# Altium schematic sheet 10.RK3588_Power_GND.SchDoc
size 594 x 420 mm; Revision: V2.1; Schematic Page Number: 11; Page Number: 10; Check: <Checker>; Schematic Name: RK_NVR_DEMO1_RK3588_LP4/4x_V21; Page Count: 43; Page name: 10.RK3588_Power/GND; Designer: Zhangdz; Schematic Page Count: 99; Revcode: V2.1; DsnPath: E:\Work\SBER\RK3588_SOM\temp\RK_NVR_DEMO1_RK3588_LP4XD200P232SD8_V21_20211228.DSN; SchematicName: RK_NVR_DEMO1_RK3588_LP4/4x_V21; PageName: 10.RK3588_Power/GND; PageSize: A2; TopSchematic: True
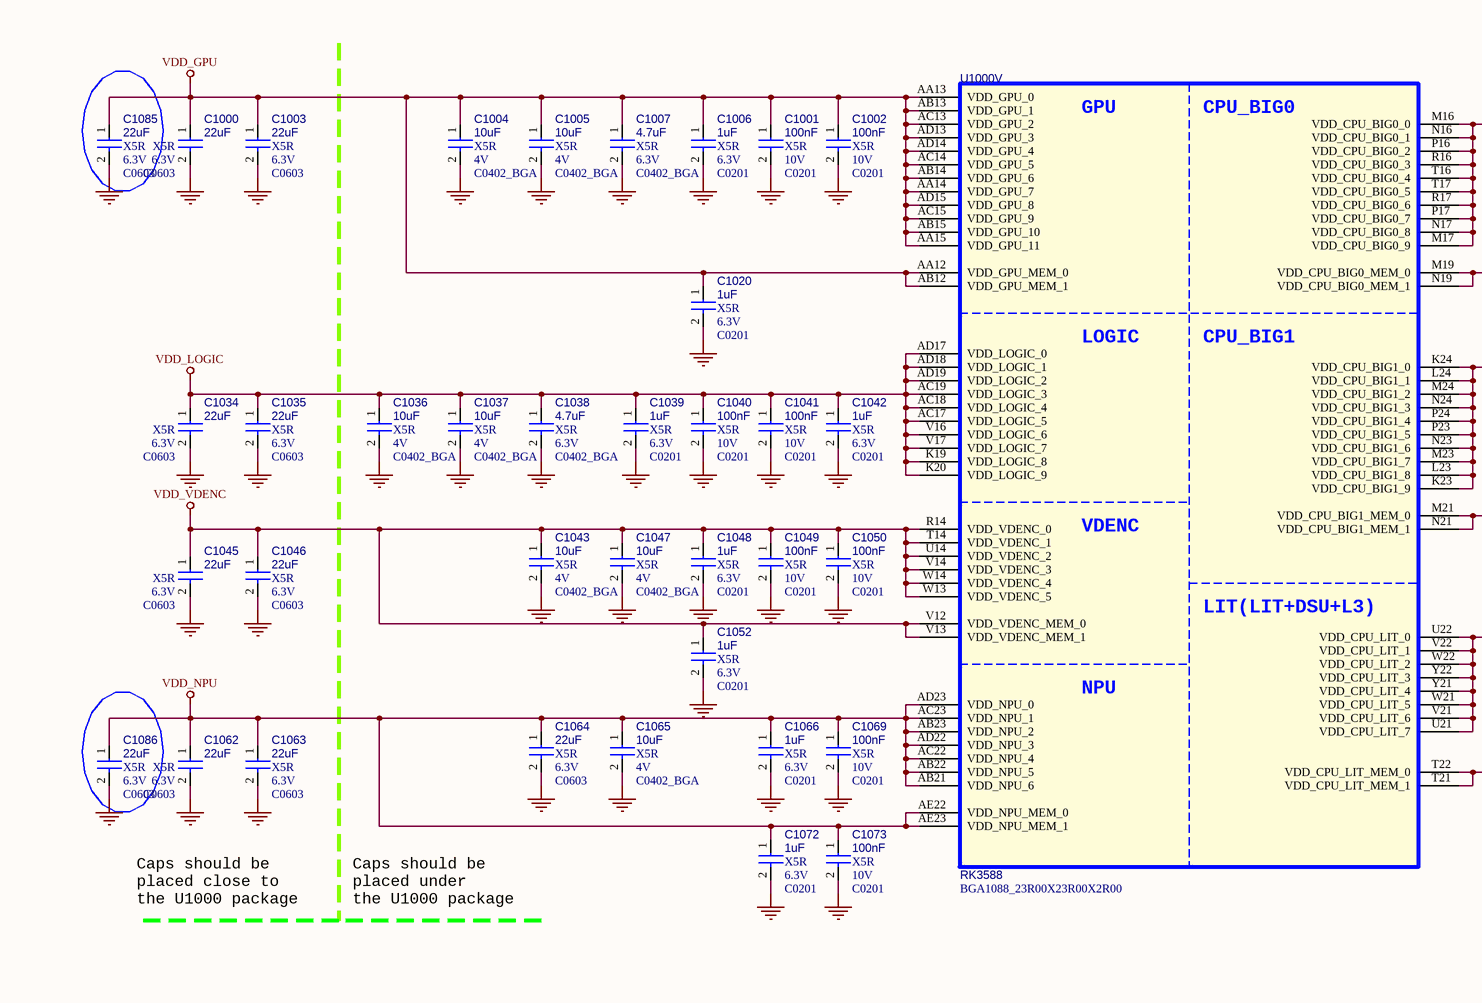
[diagram p0: 10.RK3588_Power_GND.SchDoc, top left]
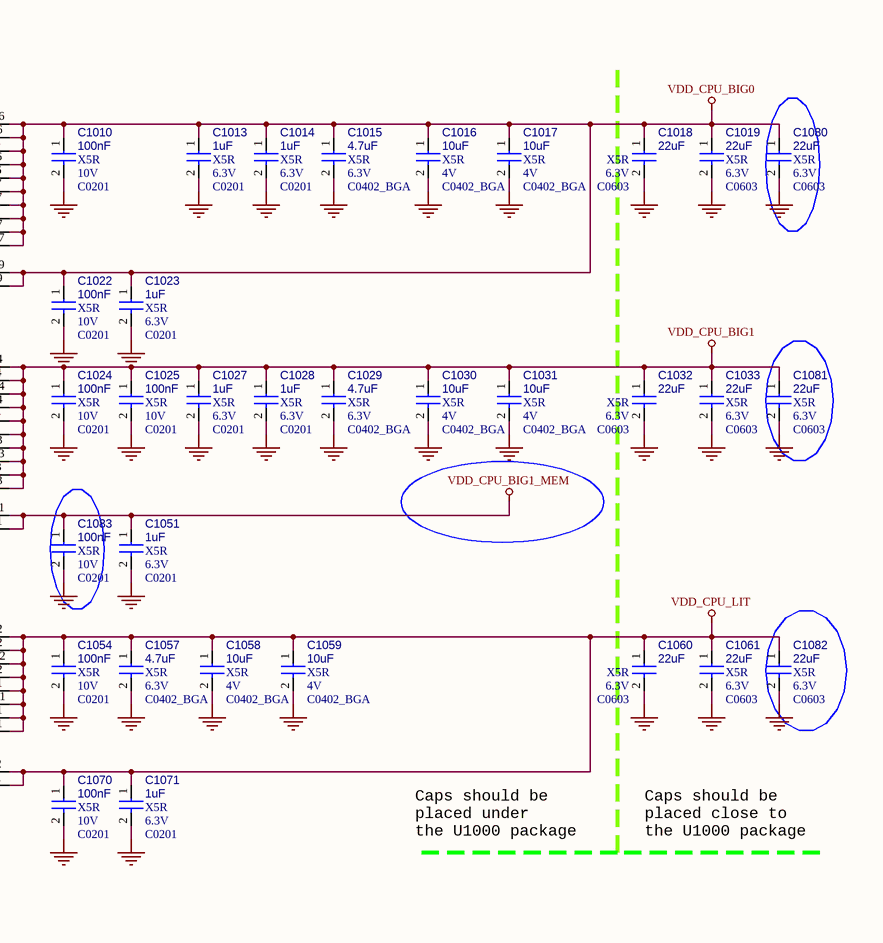
[diagram p1: 10.RK3588_Power_GND.SchDoc, top right]
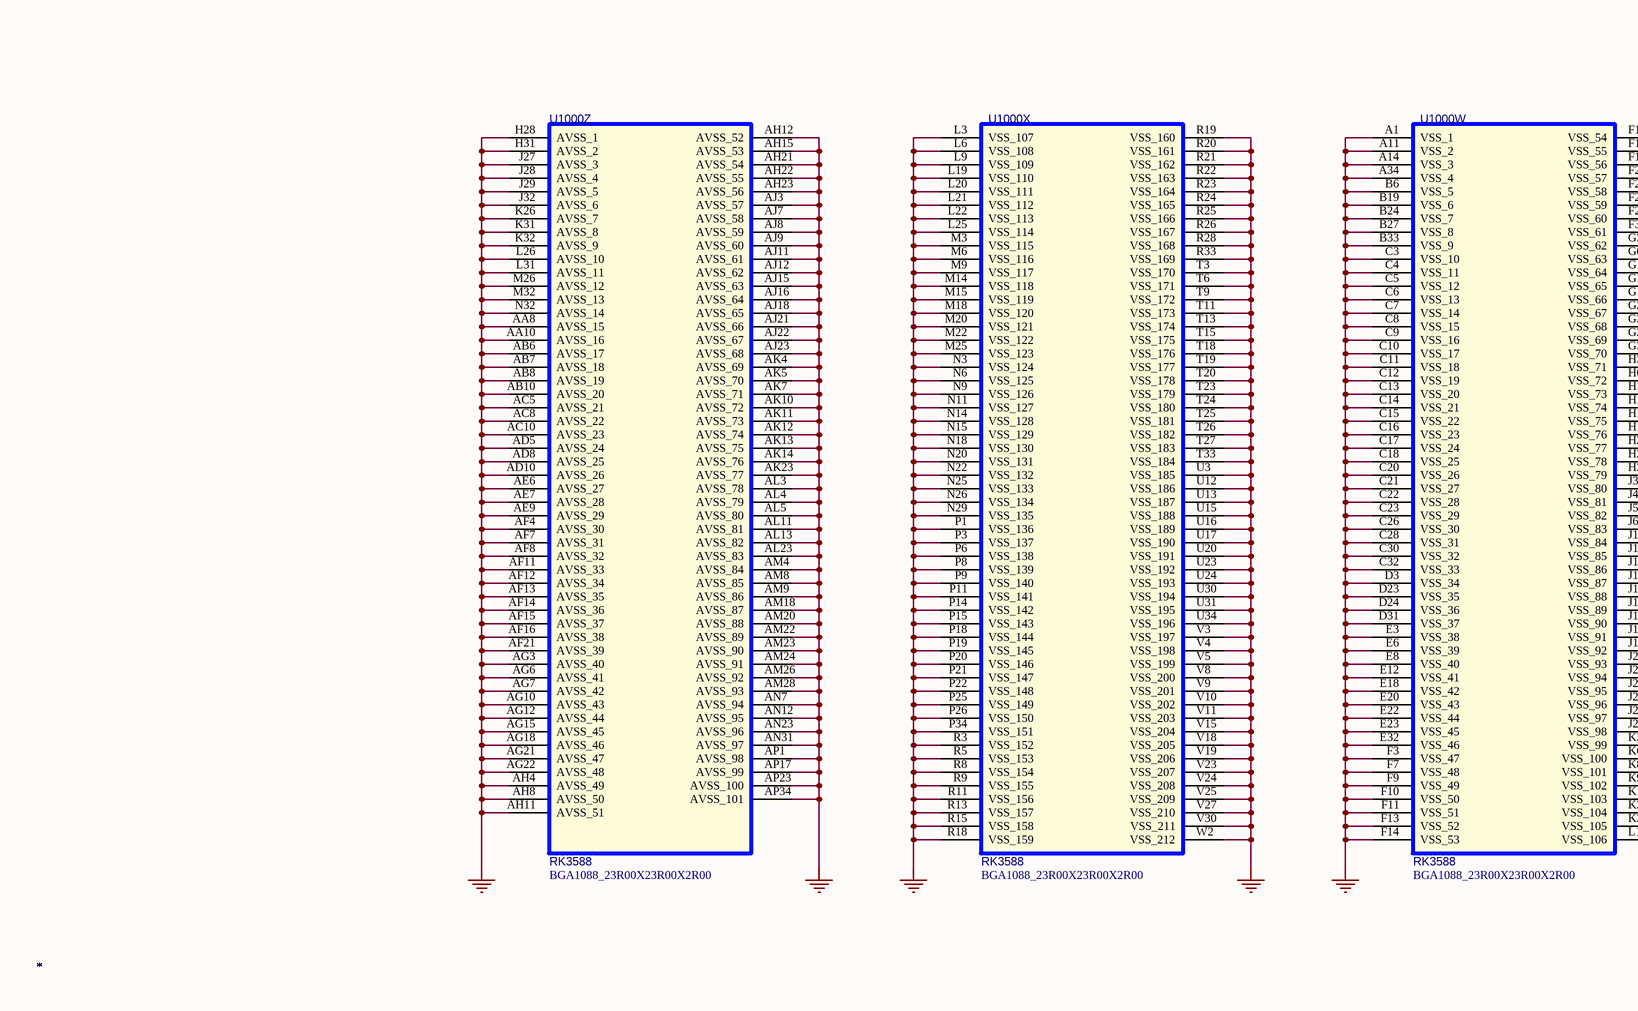
[diagram p2: 10.RK3588_Power_GND.SchDoc, bottom left]
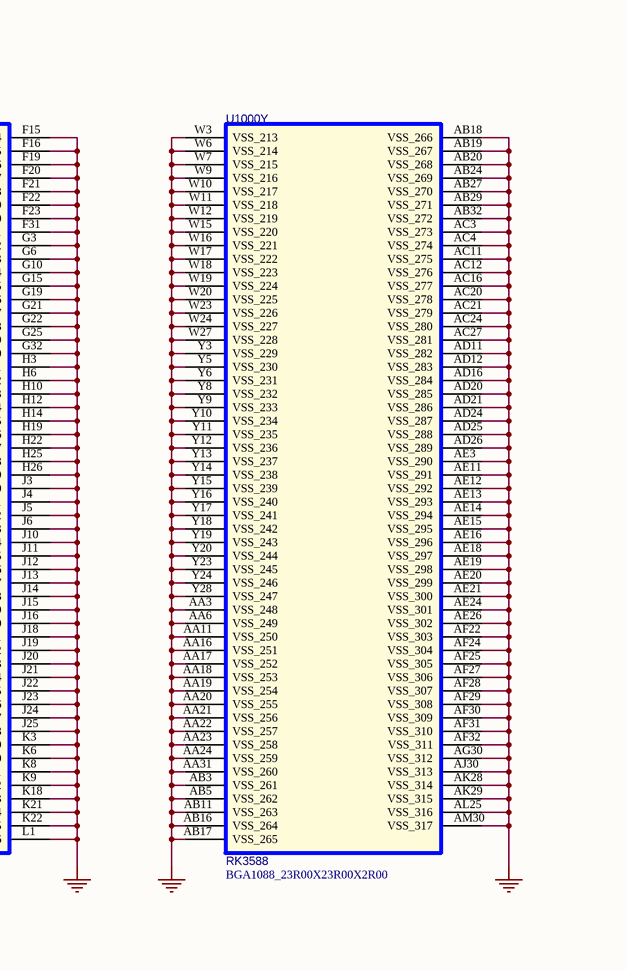
[diagram p3: 10.RK3588_Power_GND.SchDoc, bottom right]

## Parts
C1000  *  Voltage: 6.3V  Dielectric: X5R  [C0603]
C1001  *  Voltage: 10V  Dielectric: X5R  [C0201]
C1002  *  Voltage: 10V  Dielectric: X5R  [C0201]
C1003  *  Voltage: 6.3V  Dielectric: X5R  [C0603]
C1004  *  Voltage: 4V  Dielectric: X5R  [C0402_BGA]
C1005  *  Voltage: 4V  Dielectric: X5R  [C0402_BGA]
C1006  *  Voltage: 6.3V  Dielectric: X5R  [C0201]
C1007  *  Voltage: 6.3V  Dielectric: X5R  [C0402_BGA]
C1010  *  Voltage: 10V  Dielectric: X5R  [C0201]
C1013  *  Voltage: 6.3V  Dielectric: X5R  [C0201]
C1014  *  Voltage: 6.3V  Dielectric: X5R  [C0201]
C1015  *  Voltage: 6.3V  Dielectric: X5R  [C0402_BGA]
C1016  *  Voltage: 4V  Dielectric: X5R  [C0402_BGA]
C1017  *  Voltage: 4V  Dielectric: X5R  [C0402_BGA]
C1018  *  Voltage: 6.3V  Dielectric: X5R  [C0603]
C1019  *  Voltage: 6.3V  Dielectric: X5R  [C0603]
C1020  *  Voltage: 6.3V  Dielectric: X5R  [C0201]
C1022  *  Voltage: 10V  Dielectric: X5R  [C0201]
C1023  *  Voltage: 6.3V  Dielectric: X5R  [C0201]
C1024  *  Voltage: 10V  Dielectric: X5R  [C0201]
C1025  *  Voltage: 10V  Dielectric: X5R  [C0201]
C1027  *  Voltage: 6.3V  Dielectric: X5R  [C0201]
C1028  *  Voltage: 6.3V  Dielectric: X5R  [C0201]
C1029  *  Voltage: 6.3V  Dielectric: X5R  [C0402_BGA]
C1030  *  Voltage: 4V  Dielectric: X5R  [C0402_BGA]
C1031  *  Voltage: 4V  Dielectric: X5R  [C0402_BGA]
C1032  *  Voltage: 6.3V  Dielectric: X5R  [C0603]
C1033  *  Voltage: 6.3V  Dielectric: X5R  [C0603]
C1034  *  Voltage: 6.3V  Dielectric: X5R  [C0603]
C1035  *  Voltage: 6.3V  Dielectric: X5R  [C0603]
C1036  *  Voltage: 4V  Dielectric: X5R  [C0402_BGA]
C1037  *  Voltage: 4V  Dielectric: X5R  [C0402_BGA]
C1038  *  Voltage: 6.3V  Dielectric: X5R  [C0402_BGA]
C1039  *  Voltage: 6.3V  Dielectric: X5R  [C0201]
C1040  *  Voltage: 10V  Dielectric: X5R  [C0201]
C1041  *  Voltage: 10V  Dielectric: X5R  [C0201]
C1042  *  Voltage: 6.3V  Dielectric: X5R  [C0201]
C1043  *  Voltage: 4V  Dielectric: X5R  [C0402_BGA]
C1045  *  Voltage: 6.3V  Dielectric: X5R  [C0603]
C1046  *  Voltage: 6.3V  Dielectric: X5R  [C0603]
C1047  *  Voltage: 4V  Dielectric: X5R  [C0402_BGA]
C1048  *  Voltage: 6.3V  Dielectric: X5R  [C0201]
C1049  *  Voltage: 10V  Dielectric: X5R  [C0201]
C1050  *  Voltage: 10V  Dielectric: X5R  [C0201]
C1051  *  Voltage: 6.3V  Dielectric: X5R  [C0201]
C1052  *  Voltage: 6.3V  Dielectric: X5R  [C0201]
C1054  *  Voltage: 10V  Dielectric: X5R  [C0201]
C1057  *  Voltage: 6.3V  Dielectric: X5R  [C0402_BGA]
C1058  *  Voltage: 4V  Dielectric: X5R  [C0402_BGA]
C1059  *  Voltage: 4V  Dielectric: X5R  [C0402_BGA]
C1060  *  Voltage: 6.3V  Dielectric: X5R  [C0603]
C1061  *  Voltage: 6.3V  Dielectric: X5R  [C0603]
C1062  *  Voltage: 6.3V  Dielectric: X5R  [C0603]
C1063  *  Voltage: 6.3V  Dielectric: X5R  [C0603]
C1064  *  Voltage: 6.3V  Dielectric: X5R  [C0603]
C1065  *  Voltage: 4V  Dielectric: X5R  [C0402_BGA]
C1066  *  Voltage: 6.3V  Dielectric: X5R  [C0201]
C1069  *  Voltage: 10V  Dielectric: X5R  [C0201]
C1070  *  Voltage: 10V  Dielectric: X5R  [C0201]
C1071  *  Voltage: 6.3V  Dielectric: X5R  [C0201]
C1072  *  Voltage: 6.3V  Dielectric: X5R  [C0201]
C1073  *  Voltage: 10V  Dielectric: X5R  [C0201]
C1080  *  Voltage: 6.3V  Dielectric: X5R  [C0603]
C1081  *  Voltage: 6.3V  Dielectric: X5R  [C0603]
C1082  *  Voltage: 6.3V  Dielectric: X5R  [C0603]
C1083  *  Voltage: 10V  Dielectric: X5R  [C0201]
C1085  *  Voltage: 6.3V  Dielectric: X5R  [C0603]
C1086  *  Voltage: 6.3V  Dielectric: X5R  [C0603]
U1000  *  [BGA1088_23R00X23R00X2R00]  (parts V,W,X,Y,Z of 26)

## Nets
GND: C1000.2 C1001.2 C1002.2 C1003.2 C1004.2 C1005.2 C1006.2 C1007.2 C1010.2 C1013.2 C1014.2 C1015.2 C1016.2 C1017.2 C1018.2 C1019.2 C1020.2 C1022.2 C1023.2 C1024.2 C1025.2 C1027.2 C1028.2 C1029.2 C1030.2 C1031.2 C1032.2 C1033.2 C1034.2 C1035.2 C1036.2 C1037.2 C1038.2 C1039.2 C1040.2 C1041.2 C1042.2 C1043.2 C1045.2 C1046.2 C1047.2 C1048.2 C1049.2 C1050.2 C1051.2 C1052.2 C1054.2 C1057.2 C1058.2 C1059.2 C1060.2 C1061.2 C1062.2 C1063.2 C1064.2 C1065.2 C1066.2 C1069.2 C1070.2 C1071.2 C1072.2 C1073.2 C1080.2 C1081.2 C1082.2 C1083.2 C1085.2 C1086.2 U1000.A1(VSS_1) U1000.A11(VSS_2) U1000.A14(VSS_3) U1000.A34(VSS_4) U1000.AA3(VSS_248) U1000.AA6(VSS_249) U1000.AA8(AVSS_15) U1000.AA10(AVSS_16) U1000.AA11(VSS_250) U1000.AA16(VSS_251) U1000.AA17(VSS_252) U1000.AA18(VSS_253) U1000.AA19(VSS_254) U1000.AA20(VSS_255) U1000.AA21(VSS_256) U1000.AA22(VSS_257) U1000.AA23(VSS_258) U1000.AA24(VSS_259) U1000.AA31(VSS_260) U1000.AB3(VSS_261) U1000.AB5(VSS_262) U1000.AB6(AVSS_17) U1000.AB7(AVSS_18) U1000.AB8(AVSS_19) U1000.AB10(AVSS_20) U1000.AB11(VSS_263) U1000.AB16(VSS_264) U1000.AB17(VSS_265) U1000.AB18(VSS_266) U1000.AB19(VSS_267) U1000.AB20(VSS_268) U1000.AB24(VSS_269) U1000.AB27(VSS_270) U1000.AB29(VSS_271) U1000.AB32(VSS_272) U1000.AC3(VSS_273) U1000.AC4(VSS_274) U1000.AC5(AVSS_21) U1000.AC8(AVSS_22) U1000.AC10(AVSS_23) U1000.AC11(VSS_275) U1000.AC12(VSS_276) U1000.AC16(VSS_277) U1000.AC20(VSS_278) U1000.AC21(VSS_279) U1000.AC24(VSS_280) U1000.AC27(VSS_281) U1000.AD5(AVSS_24) U1000.AD8(AVSS_25) U1000.AD10(AVSS_26) U1000.AD11(VSS_282) U1000.AD12(VSS_283) U1000.AD16(VSS_284) U1000.AD20(VSS_285) U1000.AD21(VSS_286) U1000.AD24(VSS_287) U1000.AD25(VSS_288) U1000.AD26(VSS_289) U1000.AE3(VSS_290) U1000.AE6(AVSS_27) U1000.AE7(AVSS_28) U1000.AE9(AVSS_29) U1000.AE11(VSS_291) U1000.AE12(VSS_292) U1000.AE13(VSS_293) U1000.AE14(VSS_294) U1000.AE15(VSS_295) U1000.AE16(VSS_296) U1000.AE18(VSS_297) U1000.AE19(VSS_298) U1000.AE20(VSS_299) U1000.AE21(VSS_300) U1000.AE24(VSS_301) U1000.AE26(VSS_302) U1000.AF4(AVSS_30) U1000.AF7(AVSS_31) U1000.AF8(AVSS_32) U1000.AF11(AVSS_33) U1000.AF12(AVSS_34) U1000.AF13(AVSS_35) U1000.AF14(AVSS_36) U1000.AF15(AVSS_37) U1000.AF16(AVSS_38) U1000.AF21(AVSS_39) U1000.AF22(VSS_303) U1000.AF24(VSS_304) U1000.AF25(VSS_305) U1000.AF27(VSS_306) U1000.AF28(VSS_307) U1000.AF29(VSS_308) U1000.AF30(VSS_309) U1000.AF31(VSS_310) U1000.AF32(VSS_311) U1000.AG3(AVSS_40) U1000.AG6(AVSS_41) U1000.AG7(AVSS_42) U1000.AG10(AVSS_43) U1000.AG12(AVSS_44) U1000.AG15(AVSS_45) U1000.AG18(AVSS_46) U1000.AG21(AVSS_47) U1000.AG22(AVSS_48) U1000.AG30(VSS_312) U1000.AH4(AVSS_49) U1000.AH8(AVSS_50) U1000.AH11(AVSS_51) U1000.AH12(AVSS_52) U1000.AH15(AVSS_53) U1000.AH21(AVSS_54) U1000.AH22(AVSS_55) U1000.AH23(AVSS_56) U1000.AJ3(AVSS_57) U1000.AJ7(AVSS_58) U1000.AJ8(AVSS_59) U1000.AJ9(AVSS_60) U1000.AJ11(AVSS_61) U1000.AJ12(AVSS_62) U1000.AJ15(AVSS_63) U1000.AJ16(AVSS_64) U1000.AJ18(AVSS_65) U1000.AJ21(AVSS_66) U1000.AJ22(AVSS_67) U1000.AJ23(AVSS_68) U1000.AJ30(VSS_313) U1000.AK4(AVSS_69) U1000.AK5(AVSS_70) U1000.AK7(AVSS_71) U1000.AK10(AVSS_72) U1000.AK11(AVSS_73) U1000.AK12(AVSS_74) U1000.AK13(AVSS_75) U1000.AK14(AVSS_76) U1000.AK23(AVSS_77) U1000.AK28(VSS_314) U1000.AK29(VSS_315) U1000.AL3(AVSS_78) U1000.AL4(AVSS_79) U1000.AL5(AVSS_80) U1000.AL11(AVSS_81) U1000.AL13(AVSS_82) U1000.AL23(AVSS_83) U1000.AL25(VSS_316) U1000.AM4(AVSS_84) U1000.AM8(AVSS_85) U1000.AM9(AVSS_86) U1000.AM18(AVSS_87) U1000.AM20(AVSS_88) U1000.AM22(AVSS_89) U1000.AM23(AVSS_90) U1000.AM24(AVSS_91) U1000.AM26(AVSS_92) U1000.AM28(AVSS_93) U1000.AM30(VSS_317) U1000.AN7(AVSS_94) U1000.AN12(AVSS_95) U1000.AN23(AVSS_96) U1000.AN31(AVSS_97) U1000.AP1(AVSS_98) U1000.AP17(AVSS_99) U1000.AP23(AVSS_100) U1000.AP34(AVSS_101) U1000.B6(VSS_5) U1000.B19(VSS_6) U1000.B24(VSS_7) U1000.B27(VSS_8) U1000.B33(VSS_9) U1000.C3(VSS_10) U1000.C4(VSS_11) U1000.C5(VSS_12) U1000.C6(VSS_13) U1000.C7(VSS_14) U1000.C8(VSS_15) U1000.C9(VSS_16) U1000.C10(VSS_17) U1000.C11(VSS_18) U1000.C12(VSS_19) U1000.C13(VSS_20) U1000.C14(VSS_21) U1000.C15(VSS_22) U1000.C16(VSS_23) U1000.C17(VSS_24) U1000.C18(VSS_25) U1000.C20(VSS_26) U1000.C21(VSS_27) U1000.C22(VSS_28) U1000.C23(VSS_29) U1000.C26(VSS_30) U1000.C28(VSS_31) U1000.C30(VSS_32) U1000.C32(VSS_33) U1000.D3(VSS_34) U1000.D23(VSS_35) U1000.D24(VSS_36) U1000.D31(VSS_37) U1000.E3(VSS_38) U1000.E6(VSS_39) U1000.E8(VSS_40) U1000.E12(VSS_41) U1000.E18(VSS_42) U1000.E20(VSS_43) U1000.E22(VSS_44) U1000.E23(VSS_45) U1000.E32(VSS_46) U1000.F3(VSS_47) U1000.F7(VSS_48) U1000.F9(VSS_49) U1000.F10(VSS_50) U1000.F11(VSS_51) U1000.F13(VSS_52) U1000.F14(VSS_53) U1000.F15(VSS_54) U1000.F16(VSS_55) U1000.F19(VSS_56) U1000.F20(VSS_57) U1000.F21(VSS_58) U1000.F22(VSS_59) U1000.F23(VSS_60) U1000.F31(VSS_61) U1000.G3(VSS_62) U1000.G6(VSS_63) U1000.G10(VSS_64) U1000.G15(VSS_65) U1000.G19(VSS_66) U1000.G21(VSS_67) U1000.G22(VSS_68) U1000.G25(VSS_69) U1000.G32(VSS_70) U1000.H3(VSS_71) U1000.H6(VSS_72) U1000.H10(VSS_73) U1000.H12(VSS_74) U1000.H14(VSS_75) U1000.H19(VSS_76) U1000.H22(VSS_77) U1000.H25(VSS_78) U1000.H26(VSS_79) U1000.H28(AVSS_1) U1000.H31(AVSS_2) U1000.J3(VSS_80) U1000.J4(VSS_81) U1000.J5(VSS_82) U1000.J6(VSS_83) U1000.J10(VSS_84) U1000.J11(VSS_85) U1000.J12(VSS_86) U1000.J13(VSS_87) U1000.J14(VSS_88) U1000.J15(VSS_89) U1000.J16(VSS_90) U1000.J18(VSS_91) U1000.J19(VSS_92) U1000.J20(VSS_93) U1000.J21(VSS_94) U1000.J22(VSS_95) U1000.J23(VSS_96) U1000.J24(VSS_97) U1000.J25(VSS_98) U1000.J27(AVSS_3) U1000.J28(AVSS_4) U1000.J29(AVSS_5) U1000.J32(AVSS_6) U1000.K3(VSS_99) U1000.K6(VSS_100) U1000.K8(VSS_101) U1000.K9(VSS_102) U1000.K18(VSS_103) U1000.K21(VSS_104) U1000.K22(VSS_105) U1000.K26(AVSS_7) U1000.K31(AVSS_8) U1000.K32(AVSS_9) U1000.L1(VSS_106) U1000.L3(VSS_107) U1000.L6(VSS_108) U1000.L9(VSS_109) U1000.L19(VSS_110) U1000.L20(VSS_111) U1000.L21(VSS_112) U1000.L22(VSS_113) U1000.L25(VSS_114) U1000.L26(AVSS_10) U1000.L31(AVSS_11) U1000.M3(VSS_115) U1000.M6(VSS_116) U1000.M9(VSS_117) U1000.M14(VSS_118) U1000.M15(VSS_119) U1000.M18(VSS_120) U1000.M20(VSS_121) U1000.M22(VSS_122) U1000.M25(VSS_123) U1000.M26(AVSS_12) U1000.M32(AVSS_13) U1000.N3(VSS_124) U1000.N6(VSS_125) U1000.N9(VSS_126) U1000.N11(VSS_127) U1000.N14(VSS_128) U1000.N15(VSS_129) U1000.N18(VSS_130) U1000.N20(VSS_131) U1000.N22(VSS_132) U1000.N25(VSS_133) U1000.N26(VSS_134) U1000.N29(VSS_135) U1000.N32(AVSS_14) U1000.P1(VSS_136) U1000.P3(VSS_137) U1000.P6(VSS_138) U1000.P8(VSS_139) U1000.P9(VSS_140) U1000.P11(VSS_141) U1000.P14(VSS_142) U1000.P15(VSS_143) U1000.P18(VSS_144) U1000.P19(VSS_145) U1000.P20(VSS_146) U1000.P21(VSS_147) U1000.P22(VSS_148) U1000.P25(VSS_149) U1000.P26(VSS_150) U1000.P34(VSS_151) U1000.R3(VSS_152) U1000.R5(VSS_153) U1000.R8(VSS_154) U1000.R9(VSS_155) U1000.R11(VSS_156) U1000.R13(VSS_157) U1000.R15(VSS_158) U1000.R18(VSS_159) U1000.R19(VSS_160) U1000.R20(VSS_161) U1000.R21(VSS_162) U1000.R22(VSS_163) U1000.R23(VSS_164) U1000.R24(VSS_165) U1000.R25(VSS_166) U1000.R26(VSS_167) U1000.R28(VSS_168) U1000.R33(VSS_169) U1000.T3(VSS_170) U1000.T6(VSS_171) U1000.T9(VSS_172) U1000.T11(VSS_173) U1000.T13(VSS_174) U1000.T15(VSS_175) U1000.T18(VSS_176) U1000.T19(VSS_177) U1000.T20(VSS_178) U1000.T23(VSS_179) U1000.T24(VSS_180) U1000.T25(VSS_181) U1000.T26(VSS_182) U1000.T27(VSS_183) U1000.T33(VSS_184) U1000.U3(VSS_185) U1000.U12(VSS_186) U1000.U13(VSS_187) U1000.U15(VSS_188) U1000.U16(VSS_189) U1000.U17(VSS_190) U1000.U20(VSS_191) U1000.U23(VSS_192) U1000.U24(VSS_193) U1000.U30(VSS_194) U1000.U31(VSS_195) U1000.U34(VSS_196) U1000.V3(VSS_197) U1000.V4(VSS_198) U1000.V5(VSS_199) U1000.V8(VSS_200) U1000.V9(VSS_201) U1000.V10(VSS_202) U1000.V11(VSS_203) U1000.V15(VSS_204) U1000.V18(VSS_205) U1000.V19(VSS_206) U1000.V23(VSS_207) U1000.V24(VSS_208) U1000.V25(VSS_209) U1000.V27(VSS_210) U1000.V30(VSS_211) U1000.W2(VSS_212) U1000.W3(VSS_213) U1000.W6(VSS_214) U1000.W7(VSS_215) U1000.W9(VSS_216) U1000.W10(VSS_217) U1000.W11(VSS_218) U1000.W12(VSS_219) U1000.W15(VSS_220) U1000.W16(VSS_221) U1000.W17(VSS_222) U1000.W18(VSS_223) U1000.W19(VSS_224) U1000.W20(VSS_225) U1000.W23(VSS_226) U1000.W24(VSS_227) U1000.W27(VSS_228) U1000.Y3(VSS_229) U1000.Y5(VSS_230) U1000.Y6(VSS_231) U1000.Y8(VSS_232) U1000.Y9(VSS_233) U1000.Y10(VSS_234) U1000.Y11(VSS_235) U1000.Y12(VSS_236) U1000.Y13(VSS_237) U1000.Y14(VSS_238) U1000.Y15(VSS_239) U1000.Y16(VSS_240) U1000.Y17(VSS_241) U1000.Y18(VSS_242) U1000.Y19(VSS_243) U1000.Y20(VSS_244) U1000.Y23(VSS_245) U1000.Y24(VSS_246) U1000.Y28(VSS_247)
VDD_CPU_BIG0: C1010.1 C1013.1 C1014.1 C1015.1 C1016.1 C1017.1 C1018.1 C1019.1 C1022.1 C1023.1 C1080.1 U1000.M16(VDD_CPU_BIG0_0) U1000.M17(VDD_CPU_BIG0_9) U1000.M19(VDD_CPU_BIG0_MEM_0) U1000.N16(VDD_CPU_BIG0_1) U1000.N17(VDD_CPU_BIG0_8) U1000.N19(VDD_CPU_BIG0_MEM_1) U1000.P16(VDD_CPU_BIG0_2) U1000.P17(VDD_CPU_BIG0_7) U1000.R16(VDD_CPU_BIG0_3) U1000.R17(VDD_CPU_BIG0_6) U1000.T16(VDD_CPU_BIG0_4) U1000.T17(VDD_CPU_BIG0_5)
VDD_CPU_BIG1: C1024.1 C1025.1 C1027.1 C1028.1 C1029.1 C1030.1 C1031.1 C1032.1 C1033.1 C1081.1 U1000.K23(VDD_CPU_BIG1_9) U1000.K24(VDD_CPU_BIG1_0) U1000.L23(VDD_CPU_BIG1_8) U1000.L24(VDD_CPU_BIG1_1) U1000.M23(VDD_CPU_BIG1_7) U1000.M24(VDD_CPU_BIG1_2) U1000.N23(VDD_CPU_BIG1_6) U1000.N24(VDD_CPU_BIG1_3) U1000.P23(VDD_CPU_BIG1_5) U1000.P24(VDD_CPU_BIG1_4)
VDD_CPU_BIG1_MEM: C1051.1 C1083.1 U1000.M21(VDD_CPU_BIG1_MEM_0) U1000.N21(VDD_CPU_BIG1_MEM_1)
VDD_CPU_LIT: C1054.1 C1057.1 C1058.1 C1059.1 C1060.1 C1061.1 C1070.1 C1071.1 C1082.1 U1000.T21(VDD_CPU_LIT_MEM_1) U1000.T22(VDD_CPU_LIT_MEM_0) U1000.U21(VDD_CPU_LIT_7) U1000.U22(VDD_CPU_LIT_0) U1000.V21(VDD_CPU_LIT_6) U1000.V22(VDD_CPU_LIT_1) U1000.W21(VDD_CPU_LIT_5) U1000.W22(VDD_CPU_LIT_2) U1000.Y21(VDD_CPU_LIT_4) U1000.Y22(VDD_CPU_LIT_3)
VDD_GPU: C1000.1 C1001.1 C1002.1 C1003.1 C1004.1 C1005.1 C1006.1 C1007.1 C1020.1 C1085.1 U1000.AA12(VDD_GPU_MEM_0) U1000.AA13(VDD_GPU_0) U1000.AA14(VDD_GPU_7) U1000.AA15(VDD_GPU_11) U1000.AB12(VDD_GPU_MEM_1) U1000.AB13(VDD_GPU_1) U1000.AB14(VDD_GPU_6) U1000.AB15(VDD_GPU_10) U1000.AC13(VDD_GPU_2) U1000.AC14(VDD_GPU_5) U1000.AC15(VDD_GPU_9) U1000.AD13(VDD_GPU_3) U1000.AD14(VDD_GPU_4) U1000.AD15(VDD_GPU_8)
VDD_LOGIC: C1034.1 C1035.1 C1036.1 C1037.1 C1038.1 C1039.1 C1040.1 C1041.1 C1042.1 U1000.AC17(VDD_LOGIC_5) U1000.AC18(VDD_LOGIC_4) U1000.AC19(VDD_LOGIC_3) U1000.AD17(VDD_LOGIC_0) U1000.AD18(VDD_LOGIC_1) U1000.AD19(VDD_LOGIC_2) U1000.K19(VDD_LOGIC_8) U1000.K20(VDD_LOGIC_9) U1000.V16(VDD_LOGIC_6) U1000.V17(VDD_LOGIC_7)
VDD_NPU: C1062.1 C1063.1 C1064.1 C1065.1 C1066.1 C1069.1 C1072.1 C1073.1 C1086.1 U1000.AB21(VDD_NPU_6) U1000.AB22(VDD_NPU_5) U1000.AB23(VDD_NPU_2) U1000.AC22(VDD_NPU_4) U1000.AC23(VDD_NPU_1) U1000.AD22(VDD_NPU_3) U1000.AD23(VDD_NPU_0) U1000.AE22(VDD_NPU_MEM_0) U1000.AE23(VDD_NPU_MEM_1)
VDD_VDENC: C1043.1 C1045.1 C1046.1 C1047.1 C1048.1 C1049.1 C1050.1 C1052.1 U1000.R14(VDD_VDENC_0) U1000.T14(VDD_VDENC_1) U1000.U14(VDD_VDENC_2) U1000.V12(VDD_VDENC_MEM_0) U1000.V13(VDD_VDENC_MEM_1) U1000.V14(VDD_VDENC_3) U1000.W13(VDD_VDENC_5) U1000.W14(VDD_VDENC_4)

## Notes on the sheet
- Caps should be
  placed under
  the U1000 package
- Caps should be
  placed close to
  the U1000 package
- (in symbol SOC_RK3588, part V) GPU; CPU_BIG0; LOGIC; CPU_BIG1; VDENC; LIT(LIT+DSU+L3); NPU

## Library data of the parts
C1000 = CAP NP: cap,22.00uF,+/-20%,6.3V,X5R,C0603; Part Reference: C1000; Manufacturer PN: C1608X5R0J226M080AC; Manufacturer: TDK; Value: 22uF; Tolerance: 20%; Priority: A; PCB Footprint: C0603; Created by: JJJ; C_Voltage: 6.3V; Part Type: C0603; RK PN: C1608X5R0J226M080AC
C1001 = CAP NP: cap,100.00nF,+/-10%,10V,X5R,C0201; Part Reference: C1001; Manufacturer PN: C0603X5R1A104K030BC; Manufacturer: TDK; Value: 100nF; Tolerance: 10%; Priority: A; PCB Footprint: C0201; Created by: JJJ; Part Type: C0201; RK PN: C0603X5R1A104K030BC
C1002 = CAP NP: cap,100.00nF,+/-10%,10V,X5R,C0201; Part Reference: C1002; Manufacturer: TDK; Value: 100nF; RK PN: C0603X5R1A104K030BC; Priority: A; Tolerance: 10%; PCB Footprint: C0201; Part Type: C0201; Manufacturer PN: C0603X5R1A104K030BC; Created by: JJJ
C1003 = CAP NP: cap,22.00uF,+/-20%,6.3V,X5R,C0603; Part Reference: C1003; Manufacturer PN: C1608X5R0J226M080AC; Manufacturer: TDK; Value: 22uF; Tolerance: 20%; Priority: A; PCB Footprint: C0603; Created by: JJJ; Part Type: C0603; RK PN: C1608X5R0J226M080AC
C1004 = CAP NP: cap,10.00uF,+/-20%,4V,X5R,C0402; Part Reference: C1004; Manufacturer PN: CC0402MRX5R4BB106; Manufacturer: YAGEO; Value: 10uF; Tolerance: 20%; C_Voltage: 6.3V; Priority: A; PCB Footprint: C0402_BGA; Created by: JJJ; Part Type: C0402; RK PN: CC0402MRX5R4BB106
C1005 = CAP NP: cap,10.00uF,+/-20%,4V,X5R,C0402; Part Reference: C1005; Manufacturer: YAGEO; Value: 10uF; RK PN: CC0402MRX5R4BB106; Priority: A; C_Voltage: 6.3V; Tolerance: 20%; PCB Footprint: C0402_BGA; Part Type: C0402; Manufacturer PN: CC0402MRX5R4BB106; Created by: JJJ
C1006 = CAP NP: cap,1.00uF,+/-20%,6.3V,X5R,C0201; Part Reference: C1006; Manufacturer PN: C0603X5R0J105M030BC; Manufacturer: TDK; Value: 1uF; Tolerance: 20%; Priority: A; PCB Footprint: C0201; Created by: JJJ; Part Type: C0201; RK PN: C0603X5R0J105M030BC
C1007 = CAP NP: cap,4.70uF,+/-10%,6.3V,X5R,C0402; Part Reference: C1007; Manufacturer: TDK; Value: 4.7uF; RK PN: C1005X5R0J475K050BC; Priority: A; Tolerance: 10%; PCB Footprint: C0402_BGA; Part Type: C0402; Manufacturer PN: C1005X5R0J475K050BC; Created by: JJJ
C1010 = CAP NP: cap,100.00nF,+/-10%,10V,X5R,C0201; Part Reference: C1010; Manufacturer: TDK; Value: 100nF; RK PN: C0603X5R1A104K030BC; Priority: A; Tolerance: 10%; PCB Footprint: C0201; Part Type: C0201; Manufacturer PN: C0603X5R1A104K030BC; Created by: JJJ
C1013 = CAP NP: cap,1.00uF,+/-20%,6.3V,X5R,C0201; Part Reference: C1013; Manufacturer: TDK; Value: 1uF; RK PN: C0603X5R0J105M030BC; Priority: A; Tolerance: 20%; PCB Footprint: C0201; Part Type: C0201; Manufacturer PN: C0603X5R0J105M030BC; Created by: JJJ
C1014 = CAP NP: cap,1.00uF,+/-20%,6.3V,X5R,C0201; Part Reference: C1014; Manufacturer: TDK; Value: 1uF; RK PN: C0603X5R0J105M030BC; Priority: A; Tolerance: 20%; PCB Footprint: C0201; Part Type: C0201; Manufacturer PN: C0603X5R0J105M030BC; Created by: JJJ
C1015 = CAP NP: cap,4.70uF,+/-10%,6.3V,X5R,C0402; Part Reference: C1015; Manufacturer PN: C1005X5R0J475K050BC; Manufacturer: TDK; Value: 4.7uF; Tolerance: 10%; Priority: A; PCB Footprint: C0402_BGA; Created by: JJJ; Part Type: C0402; RK PN: C1005X5R0J475K050BC
C1016 = CAP NP: cap,10.00uF,+/-20%,4V,X5R,C0402; Part Reference: C1016; Manufacturer: YAGEO; Value: 10uF; RK PN: CC0402MRX5R4BB106; Priority: A; C_Voltage: 6.3V; Tolerance: 20%; PCB Footprint: C0402_BGA; Part Type: C0402; Manufacturer PN: CC0402MRX5R4BB106; Created by: JJJ
C1017 = CAP NP: cap,10.00uF,+/-20%,4V,X5R,C0402; Part Reference: C1017; Manufacturer: YAGEO; Value: 10uF; RK PN: CC0402MRX5R4BB106; Priority: A; C_Voltage: 6.3V; Tolerance: 20%; PCB Footprint: C0402_BGA; Part Type: C0402; Manufacturer PN: CC0402MRX5R4BB106; Created by: JJJ
C1018 = CAP NP: cap,22.00uF,+/-20%,6.3V,X5R,C0603; Part Reference: C1018; Manufacturer: TDK; Value: 22uF; RK PN: C1608X5R0J226M080AC; Priority: A; Tolerance: 20%; PCB Footprint: C0603; Part Type: C0603; C_Voltage: 6.3V; Manufacturer PN: C1608X5R0J226M080AC; Created by: JJJ
C1019 = CAP NP: cap,22.00uF,+/-20%,6.3V,X5R,C0603; Part Reference: C1019; Manufacturer: TDK; Value: 22uF; RK PN: C1608X5R0J226M080AC; Priority: A; Tolerance: 20%; PCB Footprint: C0603; Part Type: C0603; Manufacturer PN: C1608X5R0J226M080AC; Created by: JJJ
C1020 = CAP NP: cap,1.00uF,+/-20%,6.3V,X5R,C0201; Part Reference: C1020; Manufacturer PN: C0603X5R0J105M030BC; Manufacturer: TDK; Value: 1uF; Tolerance: 20%; Priority: A; PCB Footprint: C0201; Created by: JJJ; Part Type: C0201; RK PN: C0603X5R0J105M030BC
C1022 = CAP NP: cap,100.00nF,+/-10%,10V,X5R,C0201; Part Reference: C1022; Manufacturer: TDK; Value: 100nF; RK PN: C0603X5R1A104K030BC; Priority: A; Tolerance: 10%; PCB Footprint: C0201; Part Type: C0201; Manufacturer PN: C0603X5R1A104K030BC; Created by: JJJ
C1023 = CAP NP: cap,1.00uF,+/-20%,6.3V,X5R,C0201; Part Reference: C1023; Manufacturer: TDK; Value: 1uF; RK PN: C0603X5R0J105M030BC; Priority: A; Tolerance: 20%; PCB Footprint: C0201; Part Type: C0201; Manufacturer PN: C0603X5R0J105M030BC; Created by: JJJ
C1024 = CAP NP: cap,100.00nF,+/-10%,10V,X5R,C0201; Part Reference: C1024; Manufacturer: TDK; Value: 100nF; RK PN: C0603X5R1A104K030BC; Priority: A; Tolerance: 10%; PCB Footprint: C0201; Part Type: C0201; Manufacturer PN: C0603X5R1A104K030BC; Created by: JJJ
C1025 = CAP NP: cap,100.00nF,+/-10%,10V,X5R,C0201; Part Reference: C1025; Manufacturer: TDK; Value: 100nF; RK PN: C0603X5R1A104K030BC; Priority: A; Tolerance: 10%; PCB Footprint: C0201; Part Type: C0201; Manufacturer PN: C0603X5R1A104K030BC; Created by: JJJ
C1027 = CAP NP: cap,1.00uF,+/-20%,6.3V,X5R,C0201; Part Reference: C1027; Manufacturer PN: C0603X5R0J105M030BC; Manufacturer: TDK; Value: 1uF; Tolerance: 20%; Priority: A; PCB Footprint: C0201; Created by: JJJ; Part Type: C0201; RK PN: C0603X5R0J105M030BC
C1028 = CAP NP: cap,1.00uF,+/-20%,6.3V,X5R,C0201; Part Reference: C1028; Manufacturer PN: C0603X5R0J105M030BC; Manufacturer: TDK; Value: 1uF; Tolerance: 20%; Priority: A; PCB Footprint: C0201; Created by: JJJ; Part Type: C0201; RK PN: C0603X5R0J105M030BC
C1029 = CAP NP: cap,4.70uF,+/-10%,6.3V,X5R,C0402; Part Reference: C1029; Manufacturer: TDK; Value: 4.7uF; RK PN: C1005X5R0J475K050BC; Priority: A; Tolerance: 10%; PCB Footprint: C0402_BGA; Part Type: C0402; Manufacturer PN: C1005X5R0J475K050BC; Created by: JJJ
C1030 = CAP NP: cap,10.00uF,+/-20%,4V,X5R,C0402; Part Reference: C1030; Manufacturer PN: CC0402MRX5R4BB106; Manufacturer: YAGEO; Value: 10uF; Tolerance: 20%; C_Voltage: 6.3V; Priority: A; PCB Footprint: C0402_BGA; Created by: JJJ; Part Type: C0402; RK PN: CC0402MRX5R4BB106
C1031 = CAP NP: cap,10.00uF,+/-20%,4V,X5R,C0402; Part Reference: C1031; Manufacturer PN: CC0402MRX5R4BB106; Manufacturer: YAGEO; Value: 10uF; C_Voltage: 6.3V; Tolerance: 20%; Priority: A; Number: 37; PCB Footprint: C0402_BGA; Created by: JJJ; Part Type: C0402; RK PN: CC0402MRX5R4BB106
C1032 = CAP NP: cap,22.00uF,+/-20%,6.3V,X5R,C0603; Part Reference: C1032; Manufacturer: TDK; Value: 22uF; RK PN: C1608X5R0J226M080AC; Priority: A; Tolerance: 20%; PCB Footprint: C0603; Part Type: C0603; C_Voltage: 6.3V; Manufacturer PN: C1608X5R0J226M080AC; Created by: JJJ
C1033 = CAP NP: cap,22.00uF,+/-20%,6.3V,X5R,C0603; Part Reference: C1033; Manufacturer: TDK; Value: 22uF; RK PN: C1608X5R0J226M080AC; Priority: A; Tolerance: 20%; PCB Footprint: C0603; Part Type: C0603; Manufacturer PN: C1608X5R0J226M080AC; Created by: JJJ
C1034 = CAP NP: cap,22.00uF,+/-20%,6.3V,X5R,C0603; Part Reference: C1034; Manufacturer: TDK; Value: 22uF; RK PN: C1608X5R0J226M080AC; Priority: A; Tolerance: 20%; PCB Footprint: C0603; Part Type: C0603; C_Voltage: 6.3V; Manufacturer PN: C1608X5R0J226M080AC; Created by: JJJ
C1035 = CAP NP: cap,22.00uF,+/-20%,6.3V,X5R,C0603; Part Reference: C1035; Manufacturer: TDK; Value: 22uF; RK PN: C1608X5R0J226M080AC; Priority: A; Tolerance: 20%; PCB Footprint: C0603; Part Type: C0603; Manufacturer PN: C1608X5R0J226M080AC; Created by: JJJ
C1036 = CAP NP: cap,10.00uF,+/-20%,4V,X5R,C0402; Part Reference: C1036; Manufacturer: YAGEO; Value: 10uF; RK PN: CC0402MRX5R4BB106; Priority: A; C_Voltage: 6.3V; Tolerance: 20%; PCB Footprint: C0402_BGA; Part Type: C0402; Manufacturer PN: CC0402MRX5R4BB106; Created by: JJJ
C1037 = CAP NP: cap,10.00uF,+/-20%,4V,X5R,C0402; Part Reference: C1037; Manufacturer: YAGEO; Value: 10uF; RK PN: CC0402MRX5R4BB106; Priority: A; C_Voltage: 6.3V; Tolerance: 20%; PCB Footprint: C0402_BGA; Part Type: C0402; Manufacturer PN: CC0402MRX5R4BB106; Created by: JJJ
C1038 = CAP NP: cap,4.70uF,+/-10%,6.3V,X5R,C0402; Part Reference: C1038; Manufacturer: TDK; Value: 4.7uF; RK PN: C1005X5R0J475K050BC; Priority: A; Tolerance: 10%; PCB Footprint: C0402_BGA; Part Type: C0402; Manufacturer PN: C1005X5R0J475K050BC; Created by: JJJ
C1039 = CAP NP: cap,1.00uF,+/-20%,6.3V,X5R,C0201; Part Reference: C1039; Manufacturer: TDK; Value: 1uF; RK PN: C0603X5R0J105M030BC; Priority: A; Tolerance: 20%; PCB Footprint: C0201; Part Type: C0201; Manufacturer PN: C0603X5R0J105M030BC; Created by: JJJ
C1040 = CAP NP: cap,100.00nF,+/-10%,10V,X5R,C0201; Part Reference: C1040; Manufacturer: TDK; Value: 100nF; RK PN: C0603X5R1A104K030BC; Priority: A; Tolerance: 10%; PCB Footprint: C0201; Part Type: C0201; Manufacturer PN: C0603X5R1A104K030BC; Created by: JJJ
C1041 = CAP NP: cap,100.00nF,+/-10%,10V,X5R,C0201; Part Reference: C1041; Manufacturer: TDK; Value: 100nF; RK PN: C0603X5R1A104K030BC; Priority: A; Tolerance: 10%; PCB Footprint: C0201; Part Type: C0201; Manufacturer PN: C0603X5R1A104K030BC; Created by: JJJ
C1042 = CAP NP: cap,1.00uF,+/-20%,6.3V,X5R,C0201; Part Reference: C1042; Manufacturer: TDK; Value: 1uF; RK PN: C0603X5R0J105M030BC; Priority: A; Tolerance: 20%; PCB Footprint: C0201; Part Type: C0201; Manufacturer PN: C0603X5R0J105M030BC; Created by: JJJ
C1043 = CAP NP: cap,10.00uF,+/-20%,4V,X5R,C0402; Part Reference: C1043; Manufacturer PN: CC0402MRX5R4BB106; Manufacturer: YAGEO; Value: 10uF; C_Voltage: 6.3V; Tolerance: 20%; Priority: A; Number: 37; PCB Footprint: C0402_BGA; Created by: JJJ; Part Type: C0402; RK PN: CC0402MRX5R4BB106
C1045 = CAP NP: cap,22.00uF,+/-20%,6.3V,X5R,C0603; Part Reference: C1045; Manufacturer PN: C1608X5R0J226M080AC; Manufacturer: TDK; Value: 22uF; Tolerance: 20%; Priority: A; PCB Footprint: C0603; Created by: JJJ; C_Voltage: 6.3V; Part Type: C0603; RK PN: C1608X5R0J226M080AC
C1046 = CAP NP: cap,22.00uF,+/-20%,6.3V,X5R,C0603; Part Reference: C1046; Manufacturer PN: C1608X5R0J226M080AC; Manufacturer: TDK; Value: 22uF; Tolerance: 20%; Priority: A; PCB Footprint: C0603; Created by: JJJ; Part Type: C0603; RK PN: C1608X5R0J226M080AC
C1047 = CAP NP: cap,10.00uF,+/-20%,4V,X5R,C0402; Part Reference: C1047; Manufacturer: YAGEO; Value: 10uF; RK PN: CC0402MRX5R4BB106; Priority: A; C_Voltage: 6.3V; Tolerance: 20%; PCB Footprint: C0402_BGA; Part Type: C0402; Manufacturer PN: CC0402MRX5R4BB106; Created by: JJJ
C1048 = CAP NP: cap,1.00uF,+/-20%,6.3V,X5R,C0201; Part Reference: C1048; Manufacturer: TDK; Value: 1uF; RK PN: C0603X5R0J105M030BC; Priority: A; Tolerance: 20%; PCB Footprint: C0201; Part Type: C0201; Manufacturer PN: C0603X5R0J105M030BC; Created by: JJJ
C1049 = CAP NP: cap,100.00nF,+/-10%,10V,X5R,C0201; Part Reference: C1049; Manufacturer: TDK; Value: 100nF; RK PN: C0603X5R1A104K030BC; Priority: A; Tolerance: 10%; PCB Footprint: C0201; Part Type: C0201; Manufacturer PN: C0603X5R1A104K030BC; Created by: JJJ
C1050 = CAP NP: cap,100.00nF,+/-10%,10V,X5R,C0201; Part Reference: C1050; Manufacturer: TDK; Value: 100nF; RK PN: C0603X5R1A104K030BC; Priority: A; Tolerance: 10%; PCB Footprint: C0201; Part Type: C0201; Manufacturer PN: C0603X5R1A104K030BC; Created by: JJJ
C1051 = CAP NP: cap,1.00uF,+/-20%,6.3V,X5R,C0201; Part Reference: C1051; Manufacturer PN: C0603X5R0J105M030BC; Manufacturer: TDK; Value: 1uF; Tolerance: 20%; Priority: A; PCB Footprint: C0201; Created by: JJJ; Part Type: C0201; RK PN: C0603X5R0J105M030BC
C1052 = CAP NP: cap,1.00uF,+/-20%,6.3V,X5R,C0201; Part Reference: C1052; Manufacturer PN: C0603X5R0J105M030BC; Manufacturer: TDK; Value: 1uF; Tolerance: 20%; Priority: A; PCB Footprint: C0201; Created by: JJJ; Part Type: C0201; RK PN: C0603X5R0J105M030BC
C1054 = CAP NP: cap,100.00nF,+/-10%,10V,X5R,C0201; Part Reference: C1054; Manufacturer: TDK; Value: 100nF; RK PN: C0603X5R1A104K030BC; Priority: A; Tolerance: 10%; PCB Footprint: C0201; Part Type: C0201; Manufacturer PN: C0603X5R1A104K030BC; Created by: JJJ
C1057 = CAP NP: cap,4.70uF,+/-10%,6.3V,X5R,C0402; Part Reference: C1057; Manufacturer PN: C1005X5R0J475K050BC; Manufacturer: TDK; Value: 4.7uF; Tolerance: 10%; Priority: A; PCB Footprint: C0402_BGA; Created by: JJJ; Part Type: C0402; RK PN: C1005X5R0J475K050BC
C1058 = CAP NP: cap,10.00uF,+/-20%,4V,X5R,C0402; Part Reference: C1058; Manufacturer PN: CC0402MRX5R4BB106; Manufacturer: YAGEO; Value: 10uF; Tolerance: 20%; C_Voltage: 6.3V; Priority: A; PCB Footprint: C0402_BGA; Created by: JJJ; Part Type: C0402; RK PN: CC0402MRX5R4BB106
C1059 = CAP NP: cap,10.00uF,+/-20%,4V,X5R,C0402; Part Reference: C1059; Manufacturer: YAGEO; Value: 10uF; RK PN: CC0402MRX5R4BB106; Priority: A; C_Voltage: 6.3V; Tolerance: 20%; PCB Footprint: C0402_BGA; Part Type: C0402; Manufacturer PN: CC0402MRX5R4BB106; Created by: JJJ
C1060 = CAP NP: cap,22.00uF,+/-20%,6.3V,X5R,C0603; Part Reference: C1060; Manufacturer PN: C1608X5R0J226M080AC; Manufacturer: TDK; Value: 22uF; Tolerance: 20%; Priority: A; PCB Footprint: C0603; Created by: JJJ; C_Voltage: 6.3V; Part Type: C0603; RK PN: C1608X5R0J226M080AC
C1061 = CAP NP: cap,22.00uF,+/-20%,6.3V,X5R,C0603; Part Reference: C1061; Manufacturer PN: C1608X5R0J226M080AC; Manufacturer: TDK; Value: 22uF; Tolerance: 20%; Priority: A; PCB Footprint: C0603; Created by: JJJ; Part Type: C0603; RK PN: C1608X5R0J226M080AC
C1062 = CAP NP: cap,22.00uF,+/-20%,6.3V,X5R,C0603; Part Reference: C1062; Manufacturer PN: C1608X5R0J226M080AC; Manufacturer: TDK; Value: 22uF; Tolerance: 20%; Priority: A; PCB Footprint: C0603; Created by: JJJ; C_Voltage: 6.3V; Part Type: C0603; RK PN: C1608X5R0J226M080AC
C1063 = CAP NP: cap,22.00uF,+/-20%,6.3V,X5R,C0603; Part Reference: C1063; Manufacturer PN: C1608X5R0J226M080AC; Manufacturer: TDK; Value: 22uF; Tolerance: 20%; Priority: A; PCB Footprint: C0603; Created by: JJJ; Part Type: C0603; RK PN: C1608X5R0J226M080AC
C1064 = CAP NP: cap,22.00uF,+/-20%,6.3V,X5R,C0603; Part Reference: C1064; Manufacturer: TDK; Value: 22uF; RK PN: C1608X5R0J226M080AC; Priority: A; Tolerance: 20%; PCB Footprint: C0603; Part Type: C0603; C_Voltage: 6.3V; Manufacturer PN: C1608X5R0J226M080AC; Created by: JJJ
C1065 = CAP NP: cap,10.00uF,+/-20%,4V,X5R,C0402; Part Reference: C1065; Manufacturer: YAGEO; Value: 10uF; RK PN: CC0402MRX5R4BB106; Priority: A; C_Voltage: 6.3V; Tolerance: 20%; PCB Footprint: C0402_BGA; Part Type: C0402; Manufacturer PN: CC0402MRX5R4BB106; Created by: JJJ
C1066 = CAP NP: cap,1.00uF,+/-20%,6.3V,X5R,C0201; Part Reference: C1066; Manufacturer: TDK; Value: 1uF; RK PN: C0603X5R0J105M030BC; Priority: A; Tolerance: 20%; PCB Footprint: C0201; Part Type: C0201; Manufacturer PN: C0603X5R0J105M030BC; Created by: JJJ
C1069 = CAP NP: cap,100.00nF,+/-10%,10V,X5R,C0201; Part Reference: C1069; Manufacturer: TDK; Value: 100nF; RK PN: C0603X5R1A104K030BC; Priority: A; Tolerance: 10%; PCB Footprint: C0201; Part Type: C0201; Manufacturer PN: C0603X5R1A104K030BC; Created by: JJJ
C1070 = CAP NP: cap,100.00nF,+/-10%,10V,X5R,C0201; Part Reference: C1070; Manufacturer: TDK; Value: 100nF; RK PN: C0603X5R1A104K030BC; Priority: A; Tolerance: 10%; PCB Footprint: C0201; Part Type: C0201; Manufacturer PN: C0603X5R1A104K030BC; Created by: JJJ
C1071 = CAP NP: cap,1.00uF,+/-20%,6.3V,X5R,C0201; Part Reference: C1071; Manufacturer: TDK; Value: 1uF; RK PN: C0603X5R0J105M030BC; Priority: A; Tolerance: 20%; PCB Footprint: C0201; Part Type: C0201; Manufacturer PN: C0603X5R0J105M030BC; Created by: JJJ
C1072 = CAP NP: cap,1.00uF,+/-20%,6.3V,X5R,C0201; Part Reference: C1072; Manufacturer: TDK; Value: 1uF; RK PN: C0603X5R0J105M030BC; Priority: A; Tolerance: 20%; PCB Footprint: C0201; Part Type: C0201; Manufacturer PN: C0603X5R0J105M030BC; Created by: JJJ
C1073 = CAP NP: cap,100.00nF,+/-10%,10V,X5R,C0201; Part Reference: C1073; Manufacturer PN: C0603X5R1A104K030BC; Manufacturer: TDK; Value: 100nF; Tolerance: 10%; Priority: A; PCB Footprint: C0201; Created by: JJJ; Part Type: C0201; RK PN: C0603X5R1A104K030BC
C1080 = CAP NP: cap,22.00uF,+/-20%,6.3V,X5R,C0603; Part Reference: C1080; Manufacturer PN: C1608X5R0J226M080AC; Manufacturer: TDK; Value: 22uF; Tolerance: 20%; Priority: A; PCB Footprint: C0603; Created by: JJJ; Part Type: C0603; RK PN: C1608X5R0J226M080AC
C1081 = CAP NP: cap,22.00uF,+/-20%,6.3V,X5R,C0603; Part Reference: C1081; Manufacturer: TDK; Value: 22uF; RK PN: C1608X5R0J226M080AC; Priority: A; Tolerance: 20%; PCB Footprint: C0603; Part Type: C0603; Manufacturer PN: C1608X5R0J226M080AC; Created by: JJJ
C1082 = CAP NP: cap,22.00uF,+/-20%,6.3V,X5R,C0603; Part Reference: C1082; Manufacturer: TDK; Value: 22uF; RK PN: C1608X5R0J226M080AC; Priority: A; Tolerance: 20%; PCB Footprint: C0603; Part Type: C0603; Manufacturer PN: C1608X5R0J226M080AC; Created by: JJJ
C1083 = CAP NP: cap,100.00nF,+/-10%,10V,X5R,C0201; Part Reference: C1083; Manufacturer PN: C0603X5R1A104K030BC; Manufacturer: TDK; Value: 100nF; Tolerance: 10%; Priority: A; PCB Footprint: C0201; Created by: JJJ; Part Type: C0201; RK PN: C0603X5R1A104K030BC
C1085 = CAP NP: cap,22.00uF,+/-20%,6.3V,X5R,C0603; Part Reference: C1085; Manufacturer PN: C1608X5R0J226M080AC; Manufacturer: TDK; Value: 22uF; Tolerance: 20%; Priority: A; PCB Footprint: C0603; Created by: JJJ; Part Type: C0603; RK PN: C1608X5R0J226M080AC
C1086 = CAP NP: cap,22.00uF,+/-20%,6.3V,X5R,C0603; Part Reference: C1086; Manufacturer: TDK; Value: 22uF; RK PN: C1608X5R0J226M080AC; Priority: A; Tolerance: 20%; PCB Footprint: C0603; Part Type: C0603; Manufacturer PN: C1608X5R0J226M080AC; Created by: JJJ
U1000 = SOC_RK3588: ROCKCHIP SOC; Part Reference: U1000; Manufacturer: Rockchip (ИрРѕОў); SPLIT_INST: TRUE; SWAP_INFO: (S1+S2+S3+S4+S5+S6+S7+S8+S9+S10+S11+S12+S13+S14+S15+S16+S17+S18+S19+S20+S21+S22+S23+S24+S25+S26); Value: RK3588; Priority: A; RK PN: RK3588; Part Type: SOC; Manufacturer PN: RK3588; Created by: YWQ; PCB Footprint: BGA1088_23R00X23R00X2R00